# EasyEDA Pro project E33_Panel_2023.9.26.eprj, schematic Schematic1
Create Date: 2024-02-26; Page Name: Page1; Project Name: E33_Panel_2023.9.26; Schematic Name: Schematic1; Update Date: 2024-05-08; Company: 武汉理工大学WUTE车队; Drawed: 李家乐 姚宇; Page Size: A4; Reviewed: 肖世达; Version: V1.0
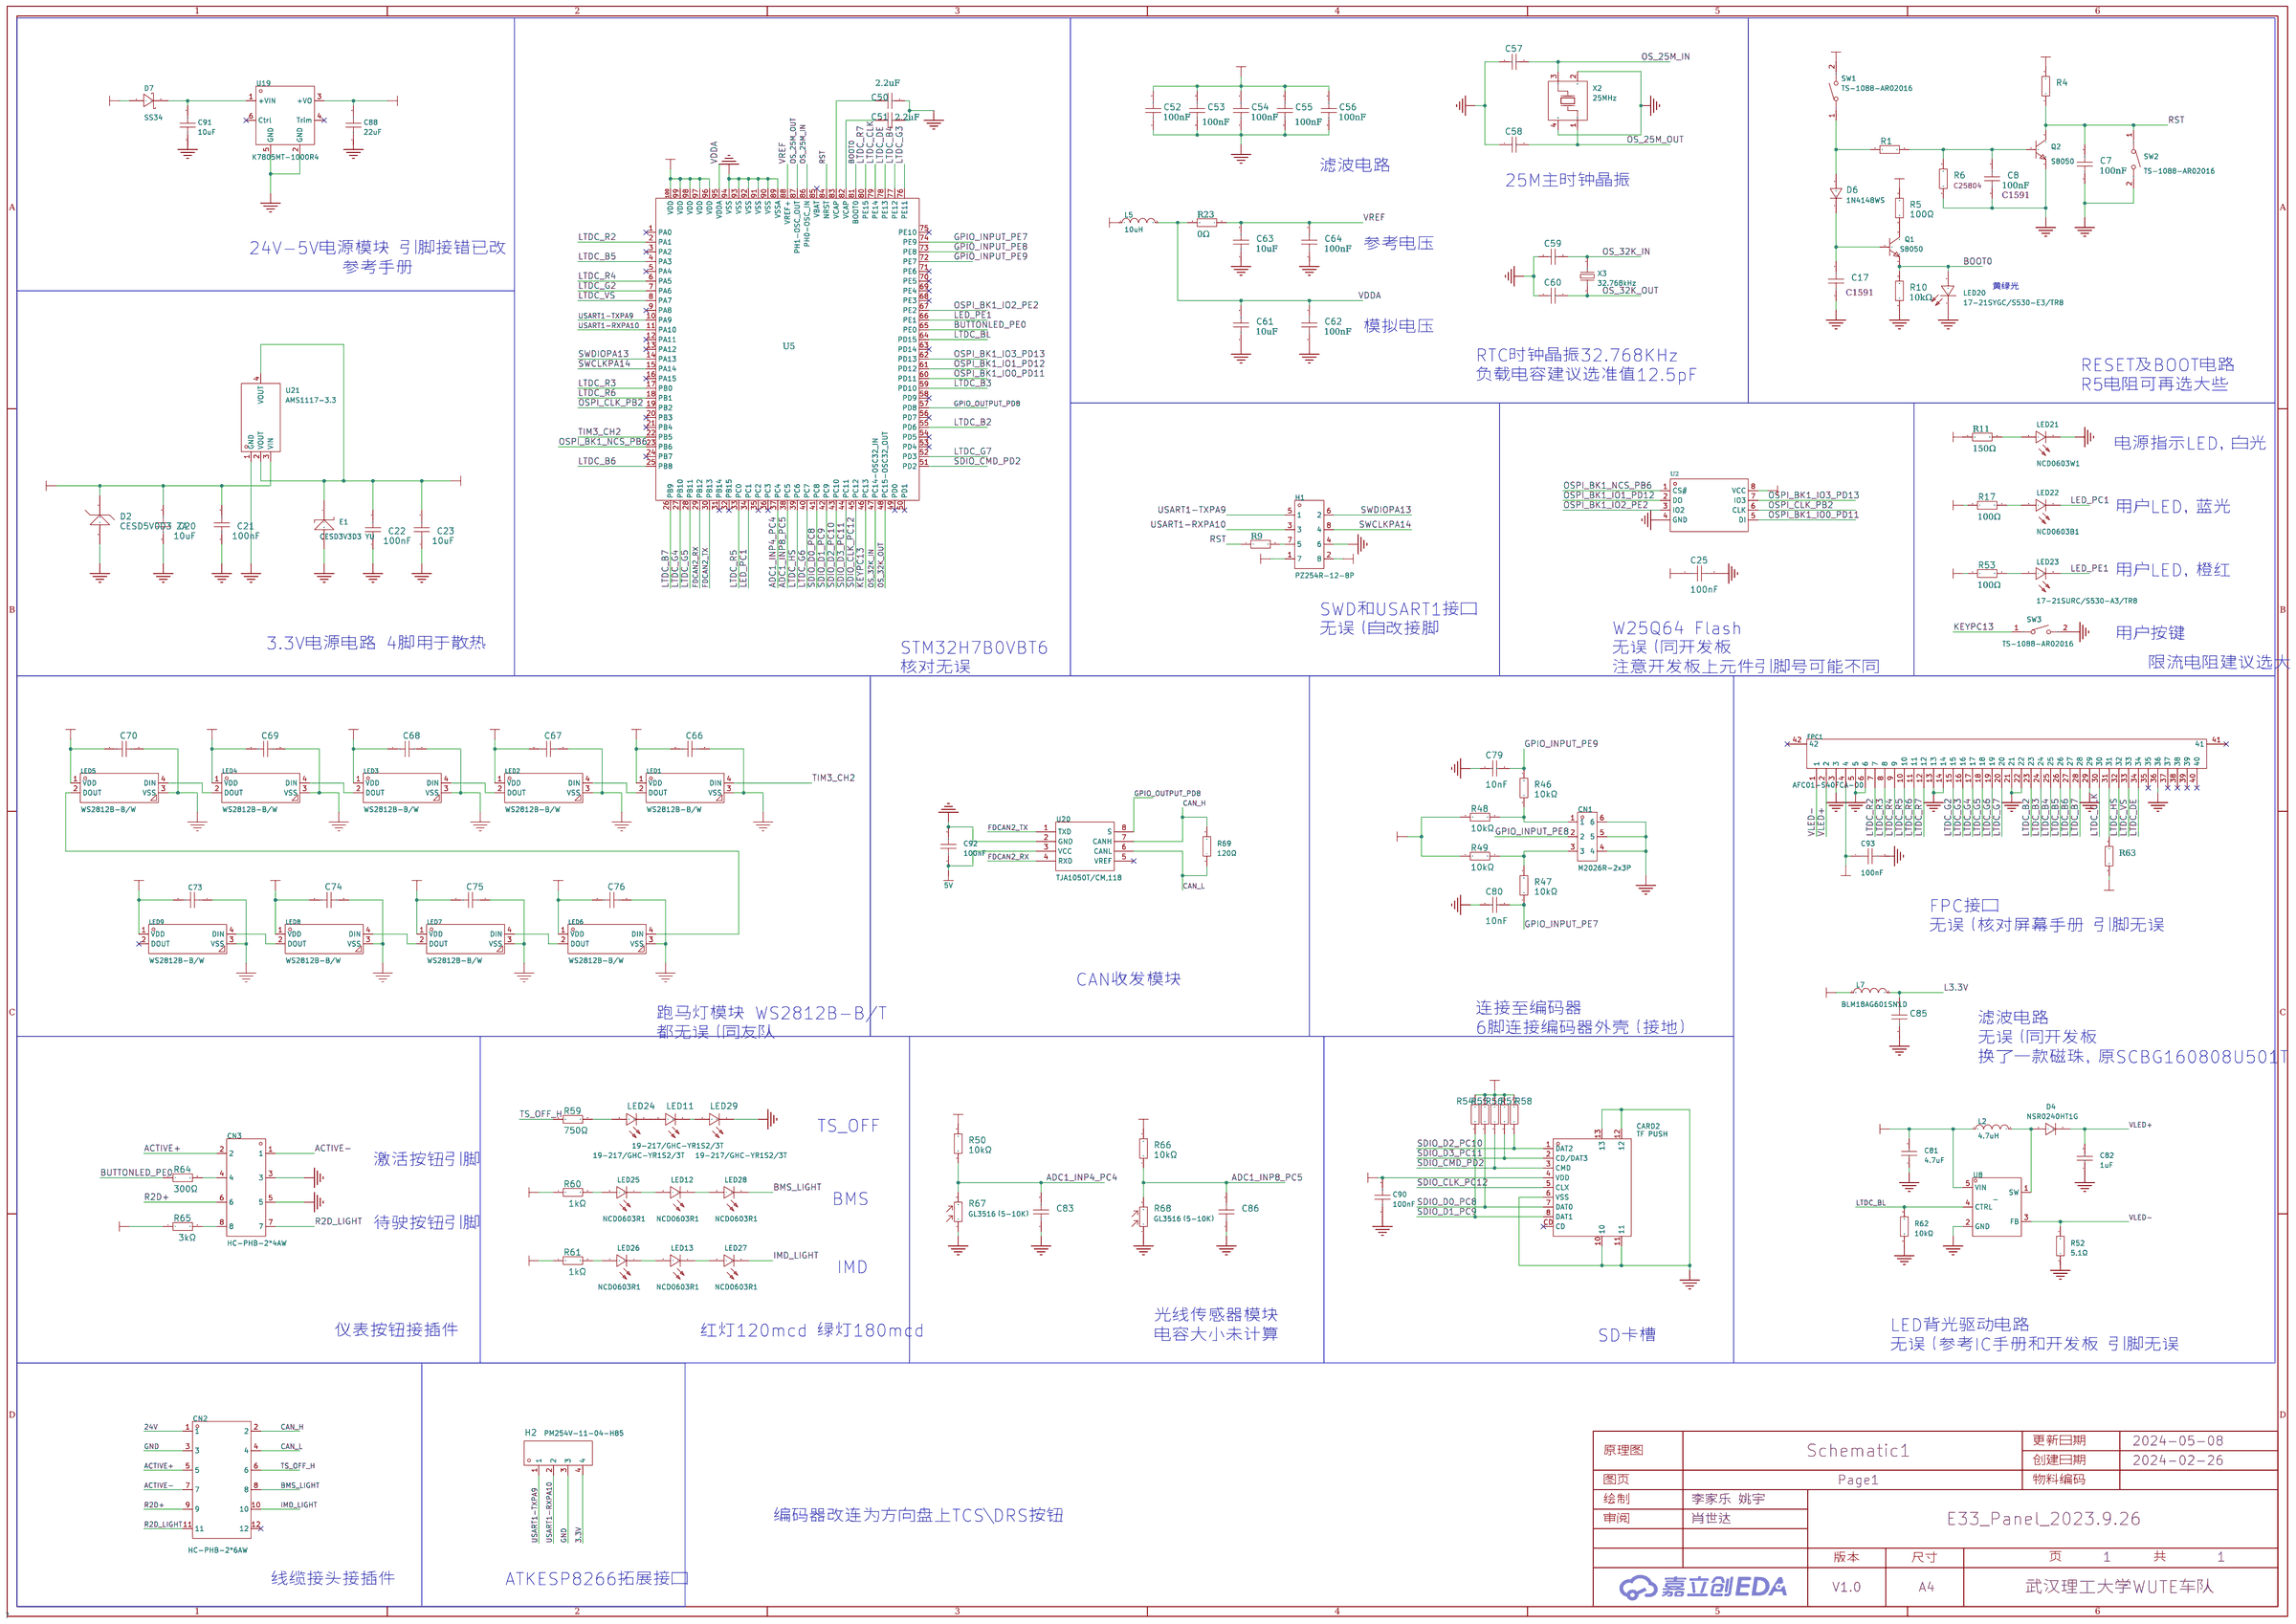
[diagram p0: schematic sheet]

## Parts
C7  100nF  [C0603]
C8  100nF  [C0603]
C17  100nF  [C0603]
C20  10uF  [C0603]
C21  100nF  [C0603]
C22  100nF  [C0603]
C23  10uF  [C0603]
C25  100nF  [C0603]
C50  2.2uF  [C0603]
C51  2.2uF  [C0603]
C52  100nF  [C0603]
C53  100nF  [C0603]
C54  100nF  [C0603]
C55  100nF  [C0603]
C56  100nF  [C0603]
C57  12pF  [C0603]
C58  12pF  [C0603]
C59  12pF  [C0603]
C60  12pF  [C0603]
C61  10uF  [C0603]
C62  100nF  [C0603]
C63  10uF  [C0603]
C64  100nF  [C0603]
C66  100nF  [C0603]
C67  100nF  [C0603]
C68  100nF  [C0603]
C69  100nF  [C0603]
C70  100nF  [C0603]
C73  100nF  [C0603]
C74  100nF  [C0603]
C75  100nF  [C0603]
C76  100nF  [C0603]
C79  10nF  [C0603]
C80  10nF  [C0603]
C81  4.7uF  [C0603]
C82  1uF  [C0603]
C83  100nF  [C0603]
C85  100nF  [C0603]
C86  100nF  [C0603]
C88  22uF  [C0603]
C90  100nF  [C0603]
C91  10uF  [C0603]
C92  100nF  [C0603]
C93  100nF  [C0603]
CARD2  TF PUSH  [TF-SMD_TF-PUSH]
CN1  M2026R-2x3P  [CONN-TH_M2026R-2X3P]
CN2  HC-PHB-2*6AW  [CONN-TH_12P-P2.00_HC-PHB-2X6AW]
CN3  HC-PHB-2*4AW  [CONN-TH_8P-P2.00_HCTL_HC-PHB-2X4AW]
D2  CESD5V0D3 ZA  [SOD-323_L1.8-W1.3-LS2.5-RD]
D4  NSR0240HT1G  [SOD-323_L1.8-W1.3-LS2.5-RD]
D6  1N4148WS  [SOD-323_L1.8-W1.3-LS2.5-RD]
D7  SS34  [SMA_L4.3-W2.6-LS5.2-RD]
E1  CESD3V3D3 YU  [SOD-323_L1.8-W1.3-LS2.5-RD]
FPC1  AFC01-S40FCA-00  [FPC-SMD_P0.50-40P_FGS-XJ-H2.0]
H1  PZ254R-12-8P  [HDR-TH_8P-P2.54-H-M-R2-C4-S2.54]
H2  PM254V-11-04-H85  [HDR-TH_4P-P2.54-V-F]
L2  4.7uH  [L0603]
L5  10uH  [L0603]
L7  BLM18AG601SN1D  [L0603]
LED1  WS2812B-B/W  [LED-SMD_4P-L5.0-W5.0-BL_TC5050RGB]
LED2  WS2812B-B/W  [LED-SMD_4P-L5.0-W5.0-BL_TC5050RGB]
LED3  WS2812B-B/W  [LED-SMD_4P-L5.0-W5.0-BL_TC5050RGB]
LED4  WS2812B-B/W  [LED-SMD_4P-L5.0-W5.0-BL_TC5050RGB]
LED5  WS2812B-B/W  [LED-SMD_4P-L5.0-W5.0-BL_TC5050RGB]
LED6  WS2812B-B/W  [LED-SMD_4P-L5.0-W5.0-BL_TC5050RGB]
LED7  WS2812B-B/W  [LED-SMD_4P-L5.0-W5.0-BL_TC5050RGB]
LED8  WS2812B-B/W  [LED-SMD_4P-L5.0-W5.0-BL_TC5050RGB]
LED9  WS2812B-B/W  [LED-SMD_4P-L5.0-W5.0-BL_TC5050RGB]
LED11  19-217/GHC-YR1S2/3T  [LED0603-RD]
LED12  NCD0603R1  [LED0603-RD_RED]
LED13  NCD0603R1  [LED0603-RD_RED]
LED20  17-21SYGC/S530-E3/TR8  [LED0805-RD]
LED21  NCD0603W1  [LED0603-RD]
LED22  NCD0603B1  [LED0603-RD]
LED23  17-21SURC/S530-A3/TR8  [LED0805-R-RD]
LED24  19-217/GHC-YR1S2/3T  [LED0603-RD]
LED25  NCD0603R1  [LED0603-RD_RED]
LED26  NCD0603R1  [LED0603-RD_RED]
LED27  NCD0603R1  [LED0603-RD_RED]
LED28  NCD0603R1  [LED0603-RD_RED]
LED29  19-217/GHC-YR1S2/3T  [LED0603-RD]
Q1  S8050  [SOT-23-3_L2.9-W1.6-P1.90-LS2.8-BR]
Q2  S8050  [SOT-23-3_L2.9-W1.6-P1.90-LS2.8-BR]
R1  10kΩ  [R0603]
R4  10kΩ  [R0603]
R5  100Ω  [R0603]
R6  10kΩ  [R0603]
R9  1kΩ  [R0603]
R10  10kΩ  [R0603]
R11  150Ω  [R0603]
R17  100Ω  [R0603]
R23  0Ω  [R0603]
R46  10kΩ  [R0603]
R47  10kΩ  [R0603]
R48  10kΩ  [R0603]
R49  10kΩ  [R0603]
R50  10kΩ  [R0603]
R52  5.1Ω  [R0603]
R53  100Ω  [R0603]
R54  10kΩ  [R0603]
R55  10kΩ  [R0603]
R56  10kΩ  [R0603]
R57  10kΩ  [R0603]
R58  10kΩ  [R0603]
R59  750Ω  [R0603]
R60  1kΩ  [R0603]
R61  1kΩ  [R0603]
R62  10kΩ  [R0603]
R63  10kΩ  [R0603]
R64  300Ω  [R0603]
R65  3kΩ  [R0603]
R66  10kΩ  [R0603]
R67  GL3516（5-10K）  [RES-TH_L5.1-W4.3-P3.40-D0.5]
R68  GL3516（5-10K）  [RES-TH_L5.1-W4.3-P3.40-D0.5]
R69  120Ω  [R0603]
SW1  TS-1088-AR02016  [SW-SMD_L3.9-W3.0-P4.45]
SW2  TS-1088-AR02016  [SW-SMD_L3.9-W3.0-P4.45]
SW3  TS-1088-AR02016  [SW-SMD_L3.9-W3.0-P4.45]
U2  W25Q64JVSSIQ  [SOP-8_L5.3-W5.3-P1.27-LS8.0-BL]
U5  STM32H7B0VBT6  [LQFP-100_L14.0-W14.0-P0.50-LS16.0-BL]
U8  -  [SC-70-5_L2.1-W1.3-P0.65-LS2.1-BR]
U19  K7805MT-1000R4  [PWRM-SMD_K78XXMT-1000R4]
U20  TJA1050T/CM,118  [SOIC-8_L5.0-W4.0-P1.27-LS6.0-BL]
U21  AMS1117-3.3  [SOT-223-3_L6.5-W3.4-P2.30-LS7.0-BR]
X2  25MHz  [OSC-SMD_4P-L3.2-W2.5-BL]
X3  32.768kHz  [FC-135R_L3.2-W1.5]

## Library data of the parts
C7 C8 C17 C21 C22 C25 C52-C56 C62 C64 C66-C70 C73-C76 C83 C85 C86 C90 C92 C93 = CL10B104KB8NNNC: 容值:100nF;精度:±10%;额定电压:50V;材质(温度系数):X7R;; LCSC Part Name: 100nF ±10% 50V; Supplier Part: C1591; Manufacturer: SAMSUNG(三星); Supplier Footprint: 0603; JLCPCB Part Class: Extended Part; Datasheet: https://atta.szlcsc.com/upload/public/pdf/source/20160103/1457707680512.pdf; Supplier: LCSC; Tolerance: ±10%; Voltage Rated: 50V; Temperature Coefficient: X7R
C20 C23 C61 C63 = CL10A106KP8NNNC: 容值:10uF;精度:±10%;额定电压:10V;材质(温度系数):X5R;; LCSC Part Name: 10uF ±10% 10V; Supplier Part: C19702; Manufacturer: SAMSUNG(三星); Supplier Footprint: 0603; JLCPCB Part Class: Basic Part; Datasheet: https://atta.szlcsc.com/upload/public/pdf/source/20160103/1457707703378.pdf; Supplier: LCSC; Tolerance: ±10%; Voltage Rated: 10V; Temperature Coefficient: X5R
C50 C51 = CL10A225KO8NNNC: 容值:2.2uF;精度:±10%;额定电压:16V;材质(温度系数):X5R;; LCSC Part Name: 2.2uF ±10% 16V; Supplier Part: C23630; Manufacturer: SAMSUNG(三星); Supplier Footprint: 0603; JLCPCB Part Class: Basic Part; Datasheet: https://atta.szlcsc.com/upload/public/pdf/source/20160103/1457707709512.pdf; Supplier: LCSC; Tolerance: ±10%; Voltage Rated: 16V; Temperature Coefficient: X5R
C57-C60 = CL10C120JB8NNNC: 容值:12pF;精度:±5%;额定电压:50V;材质(温度系数):C0G;; LCSC Part Name: 12pF ±5% 50V; Supplier Part: C38523; Manufacturer: SAMSUNG(三星); Supplier Footprint: 0603; JLCPCB Part Class: Basic Part; Datasheet: https://atta.szlcsc.com/upload/public/pdf/source/20160218/1457707763339.pdf; Supplier: LCSC; Tolerance: ±5%; Voltage Rated: 50V; Temperature Coefficient: C0G
C79 C80 = CL10B103KB8NNNC: 容值:10nF;精度:±10%;额定电压:50V;材质(温度系数):X7R;; LCSC Part Name: 10nF ±10% 50V; Supplier Part: C1589; Manufacturer: SAMSUNG(三星); Supplier Footprint: 0603; JLCPCB Part Class: Extended Part; Datasheet: https://atta.szlcsc.com/upload/public/pdf/source/20160103/1457707680084.pdf; Supplier: LCSC; Tolerance: ±10%; Voltage Rated: 50V; Temperature Coefficient: X7R
C81 = CL10A475KP8NNNC: 容值:4.7uF;精度:±10%;额定电压:10V;材质(温度系数):X5R;; LCSC Part Name: 4.7uF ±10% 10V; Supplier Part: C1705; Manufacturer: SAMSUNG(三星); Supplier Footprint: 0603; JLCPCB Part Class: Extended Part; Datasheet: https://atta.szlcsc.com/upload/public/pdf/source/20160103/1457707692180.pdf; Supplier: LCSC; Tolerance: ±10%; Voltage Rated: 10V; Temperature Coefficient: X5R
C82 = CL10A105KB8NNNC: 容值:1uF;精度:±10%;额定电压:50V;材质(温度系数):X5R;; LCSC Part Name: 1uF ±10% 50V; Supplier Part: C15849; Manufacturer: SAMSUNG(三星); Supplier Footprint: 0603; JLCPCB Part Class: Basic Part; Datasheet: https://atta.szlcsc.com/upload/public/pdf/source/20160103/1457707679084.pdf; Supplier: LCSC; Tolerance: ±10%; Voltage Rated: 50V; Temperature Coefficient: X5R
C88 = CL10A226MP8NUNE: 容值:22uF;精度:±20%;额定电压:10V;材质(温度系数):X5R;; LCSC Part Name: 22uF ±20% 10V; Supplier Part: C86295; Manufacturer: SAMSUNG(三星); Supplier Footprint: 0603; JLCPCB Part Class: Extended Part; Datasheet: https://atta.szlcsc.com/upload/public/pdf/source/20170325/1490427882169.pdf; Supplier: LCSC; Tolerance: ±20%; Voltage Rated: 10V; Temperature Coefficient: X5R
C91 = GRM188R6YA106MA73D: 容值:10uF;精度:±20%;额定电压:35V;材质(温度系数):-;; LCSC Part Name: 10uF ±20% 35V; Supplier Part: C194427; Manufacturer: muRata(村田); Supplier Footprint: 0603; JLCPCB Part Class: Extended Part; Datasheet: https://atta.szlcsc.com/upload/public/pdf/source/20210128/C194427_FCA3640823207DDB58700A82F1A19B5F.pdf; Supplier: LCSC; Tolerance: ±20%; Voltage Rated: 35V
CARD2 = TF PUSH: 卡类型:MicroSD卡(TF卡);连接器类型:卡座;卡连接方式:自弹式;本体最大高度:2mm;工作温度范围:-20℃~+90℃;; LCSC Part Name: 自弹式TF卡座 TF外焊式内存卡卡座; Supplier Part: C393941; Manufacturer: SHOU HAN(首韩); Supplier Footprint: SMD; Datasheet: https://atta.szlcsc.com/upload/public/pdf/source/20191011/C393941_0DDD896EE907FEB750D8B7B8982E2A67.pdf; Supplier: LCSC; Card Type: MicroSD卡(TF卡); Connector Type: 卡座; Card Connection Mode: 自弹式; Maximum Body Height: 2mm; Operating Temperature Range: -20℃~+90℃
CN1 = M2026R-2x3P: 参考系列:-;间距:2mm;插针结构:2x3P;排数:2;每排PIN数:3;行距:-;公母:公型插针;安装方式:弯插;额定电流:3A;工作温度范围:-25℃~+85℃;; LCSC Part Name: 2mm 2x3P 弯插; Supplier Part: C492591; Manufacturer: XFCN(兴飞); Supplier Footprint: 弯插,P=2mm; Datasheet: https://atta.szlcsc.com/upload/public/pdf/source/20200309/C492591_A3C88617EEB4152325271B39D2E99B68.pdf; Supplier: LCSC; Pitch: 2mm; Pins Structure: 2x3P; Number of Rows: 2; Number of PINs Per Row: 3; Gender: 公型插针; Mounting Style: 弯插; Current Rating (Max): 3A; Operating Temperature Range: -25℃~+85℃
CN2 = HC-PHB-2*6AW: 参考系列:-;间距:2mm;插针结构:2x6P;排数:2;每排PIN数:6;行距:2mm;公母:公型插针;安装方式:弯插;额定电流:3A;工作温度范围:-25℃~+85℃;; LCSC Part Name: 2mm 2x6P 弯插; Supplier Part: C2845599; Manufacturer: HCTL(华灿天禄); Supplier Footprint: 插件,P=2mm; Datasheet: https://atta.szlcsc.com/upload/public/pdf/source/20210728/C2845596_238E489321EB9BE37E286F652D496211.pdf; Supplier: LCSC; Pitch: 2mm; Pins Structure: 2x6P; Number of Rows: 2; Number of PINs Per Row: 6; Row Spacing: 2mm; Gender: 公型插针; Mounting Style: 弯插; Current Rating (Max): 3A; Operating Temperature Range: -25℃~+85℃
CN3 = HC-PHB-2*4AW: 参考系列:-;间距:2mm;插针结构:2x4P;排数:2;每排PIN数:4;行距:2mm;公母:公型插针;安装方式:弯插;额定电流:3A;工作温度范围:-25℃~+85℃;; LCSC Part Name: 2mm 2x4P 弯插; Supplier Part: C2845898; Manufacturer: HCTL(华灿天禄); Supplier Footprint: 弯插,P=2mm; Datasheet: https://atta.szlcsc.com/upload/public/pdf/source/20210806/C2845898_F0E6CDE538AA9F62365A2D9AC6C55FA2.pdf; Supplier: LCSC; Pitch: 2mm; Pins Structure: 2x4P; Number of Rows: 2; Number of PINs Per Row: 4; Row Spacing: 2mm; Gender: 公型插针; Mounting Style: 弯插; Current Rating (Max): 3A; Operating Temperature Range: -25℃~+85℃
D2 = CESD5V0D3 ZA: 极性:单向;反向截止电压(Vrwm):5V;击穿电压(VBR):6.2V;钳位电压(Vc)@Ipp:15.5V;; LCSC Part Name: 单向ESD; Supplier Part: C22643; Manufacturer: CJ(江苏长电/长晶); Supplier Footprint: SOD-323; JLCPCB Part Class: Extended Part; Datasheet: https://atta.szlcsc.com/upload/public/pdf/source/20140301/1457707004115.pdf; Supplier: LCSC; Polarity: 单向; Reverse Stand-Off Voltage (Vrwm): 5V; Breakdown Voltage (VBR): 6.2V; Peak Pulse Current(Ipp)@8/20us: 15A; Clamping Voltage@Ipp: 15.5V
D4 = NSR0240HT1G: 直流反向耐压(Vr):40V;平均整流电流(Io):250mA;正向压降(Vf):710mV@200mA;; LCSC Part Name: 40 V，0.25 A 低红外肖特基二极管; Supplier Part: C152519; Manufacturer: onsemi(安森美); Supplier Footprint: SOD-323; JLCPCB Part Class: Extended Part; Datasheet: https://atta.szlcsc.com/upload/public/pdf/source/20180125/C152519_15168647904761302641.PDF; Supplier: LCSC; Reverse Voltage (Vr): 40V; Average Rectified Current (Io): 250mA; Forward Voltage (Vf@If): 710mV@200mA
D6 = 1N4148WS_C2128: 二极管配置:独立式;功率:200mW;直流反向耐压(Vr):100V;平均整流电流(Io):150mA;正向压降(Vf):1.25V@150mA;反向电流(Ir):1uA@75V;反向恢复时间(trr):4ns;工作温度:+150℃@(Tj);; LCSC Part Name: 100V 150mA 4ns T4; Supplier Part: C2128; Manufacturer: CJ(江苏长电/长晶); Supplier Footprint: SOD-323; Supplier: LCSC; Diode Configuration: 独立式; Power Dissipation: 200mW; Reverse Voltage (Vr): 100V; Average Rectified Current (Io): 150mA; Forward Voltage (Vf@If): 1.25V@150mA; Reverse Leakage Current: 1uA@75V; Reverse Recovery Time (trr): 4ns; Operating Temperature: +150℃@(Tj)
D7 = SS34_C8678: 二极管配置:独立式;直流反向耐压(Vr):40V;平均整流电流(Io):3A;正向压降(Vf):550mV@3A;; LCSC Part Name: 40V 3A 550mV@3A; Supplier Part: C8678; Manufacturer: MDD; Supplier Footprint: SMA(DO-214AC); Datasheet: https://atta.szlcsc.com/upload/public/pdf/source/20230314/A80AE34493C69B89E2F4B1712F433538.pdf; Supplier: LCSC; Diode Configuration: 独立式; Reverse Voltage (Vr): 40V; Average Rectified Current (Io): 3A; Forward Voltage (Vf@If): 550mV@3A; Reverse Leakage Current (Ir): 500uA@40V
E1 = CESD3V3D3 YU: 极性:单向;反向截止电压(Vrwm):3.3V;击穿电压(VBR):5V;钳位电压(Vc)@Ipp:13V;; LCSC Part Name: 单向ESD; Supplier Part: C38388; Manufacturer: CJ(江苏长电/长晶); Supplier Footprint: SOD-323; Datasheet: https://atta.szlcsc.com/upload/public/pdf/source/20150915/1457707371129.pdf; Supplier: LCSC; Polarity: 单向; Reverse Stand-Off Voltage (Vrwm): 3.3V; Breakdown Voltage (VBR): 5V; Peak Pulse Current(Ipp)@8/20us: 16A; Clamping Voltage@Ipp: 13V
FPC1 = AFC01-S40FCA-00: 间距:0.5mm;触点数量:40;锁定特性:翻盖式;安装类型:卧贴;触点类型:下接;; LCSC Part Name: FPC 0.5MM 40P 翻盖式 H2.0mm 下接; Supplier Part: C262674; Manufacturer: JS(钜硕电子); Supplier Footprint: P=0.5mm; Supplier: LCSC; Pitch: 0.5mm; Number of Contacts: 40; Locking Feature: 翻盖式; Mounting Type: 卧贴; Contact Type: 下接; Height Above Board: 2mm; FFC, FCB Thickness: 0.3mm~0.3mm
H1 = PZ254R-12-8P: 排数:双排;总PIN位数:8P;间距:2.54mm;插针结构:2x4P;行距:2.54mm;安装类型:弯插;圆针/方针:方针;额定电流:-;额定电压:-;配合针长度:6mm;塑高:2.5mm;触头材质:黄铜;触头镀层:-;工作温度范围:-40℃~+105℃;颜色:黑色;; LCSC Part Name: 2.54mm 2x4P 弯插 方针; Supplier Part: C492432; Manufacturer: XFCN(兴飞); Supplier Footprint: 弯插,P=2.54mm; Datasheet: https://atta.szlcsc.com/upload/public/pdf/source/20200309/C492432_F55471C7391A7FE3415CB31C718B6320.pdf; Supplier: LCSC; Number of Rows: 双排; Number of Pins: 8P; Pitch: 2.54mm; Pin Structure: 2x4P; Row Spacing: 2.54mm; Mounting Type: 弯插; Circluar Pins/Square Pins: 方针; Length of Mating Pin: 6mm; Insulation Height: 2.5mm; Contact Material: 黄铜; Operating Temperature Range: -40℃~+105℃; Color: 黑色
H2 = PM254V-11-04-H85: 排数:单排;总孔位数:4;间距:2.54mm;插孔结构:1x4P;行距:-;安装类型:直插;塑高:-;触头材质:黄铜;触头镀层:-;; LCSC Part Name: 2.54mm 1x4P; Supplier Part: C541851; Manufacturer: XFCN(兴飞); Supplier Footprint: 直插,P=2.54mm; Supplier: LCSC; Number of Rows: 单排; Number of Holes: 4; Pitch: 2.54mm; Holes Structure: 1x4P; Mounting Type: 直插; Contact Material: 黄铜
L2 = SDFL1608Q4R7KTF: 电感值:4.7uH;精度:±10%;额定电流:15mA;饱和电流(Isat):-;直流电阻(DCR):2.1Ω;; LCSC Part Name: 4.7uH ±10%; Supplier Part: C1034; Manufacturer: Sunlord(顺络); Supplier Footprint: 0603; JLCPCB Part Class: Basic Part; Datasheet: https://atta.szlcsc.com/upload/public/pdf/source/20210816/855F4348312D259031B87CBCF31BE802.pdf; Supplier: LCSC; Tolerance: ±10%; Rated Current: 15mA; DC Resistance (DCR): 2.1Ω; Q @ Freq: 35@10MHz; Frequency - Self Resonant: 33MHz
L5 = MCL1608S100MT: 电感值:10uH;精度:±20%;额定电流:50mA;饱和电流(Isat):-;直流电阻(DCR):1.17Ω;; LCSC Part Name: 10uH ±20% 50mA 1.17Ω; Supplier Part: C51942; Manufacturer: Sunlord(顺络); Supplier Footprint: 0603; JLCPCB Part Class: Extended Part; Datasheet: https://atta.szlcsc.com/upload/public/pdf/source/20210916/ED8AF9AA4A96DD19D069D769FFCBDCB4.pdf; Supplier: LCSC; Tolerance: ±20%; Rated Current: 50mA; DC Resistance (DCR): 1.17Ω; Frequency - Self Resonant: 20MHz
L7 = BLM18AG601SN1D: 标称阻抗@测试频率:600Ω@100MHz;误差:±25%;直流电阻(RDC):380mΩ;; LCSC Part Name: 单路 0603磁珠 阻抗600Ω@100MHz; Supplier Part: C19330; Manufacturer: muRata(村田); Supplier Footprint: 0603; JLCPCB Part Class: Extended Part; Datasheet: https://atta.szlcsc.com/upload/public/pdf/source/20180326/C19330_93F4AC33FF94C8E22511353688ADC0FA.pdf; Supplier: LCSC; Impedance @ Frequency: 600Ω@100MHz; Tolerance: ±25%; DC Resistance: 380mΩ; Current Rating: 500mA; Circuits: 1
LED1-LED9 = WS2812B-B/W: 发光颜色:RGB三色;; LCSC Part Name: RGB三色 （注意防潮，请查阅规格书中对应具体内容）; Supplier Part: C114586; Manufacturer: worldsemi; Supplier Footprint: SMD5050; JLCPCB Part Class: 扩展库; Datasheet: https://atta.szlcsc.com/upload/public/pdf/source/20200615/C114586_26EB6813EC9F2A3F6C7FBB2AD75DE01F.pdf; Supplier: LCSC; Emitted Color: RGB三色
LED11 LED24 LED29 = 19-217/GHC-YR1S2/3T: 发光颜色:翠绿;二极管配置:-;主波长:520nm~535nm;色温:-;功率:110mW;安装方式:-;; LCSC Part Name: 翠绿; Supplier Part: C72043; Manufacturer: EVERLIGHT(亿光); Supplier Footprint: 0603; Datasheet: https://atta.szlcsc.com/upload/public/pdf/source/20160507/1462613613780.pdf; Supplier: LCSC; Emitted Color: 翠绿; Lens Color: 无色透明; Dominant Wavelength: 520nm~535nm; Peak Wavelength: 518nm; Forward Current: 20mA; Power Dissipation: 110mW; Viewing Angle: 120°; Operating Temperature: -40℃~+85℃
LED12 LED13 LED25-LED28 = NCD0603R1_C84263: 发光颜色:红灯;; LCSC Part Name: 红灯; Supplier Part: C84263; Manufacturer: 国星光电; Supplier Footprint: 0603; Datasheet: https://atta.szlcsc.com/upload/public/pdf/source/20200820/C84263_DABC6A75E58F576973B407FDBA283D60.pdf; Supplier: LCSC; Emitted Color: 红灯
LED20 = 17-21SYGC/S530-E3/TR8: 发光颜色:普绿/黄绿;; Supplier Part: C142303; Manufacturer: EVERLIGHT(亿光); Supplier Footprint: 0805; Datasheet: https://atta.szlcsc.com/upload/public/pdf/source/20171110/C142303_15102792667121104246.pdf; Supplier: LCSC; Emitted Color: 普绿/黄绿
LED21 = NCD0603W1: 发光颜色:白灯;; Supplier Part: C84265; Manufacturer: 国星光电; Supplier Footprint: 0603; Datasheet: https://atta.szlcsc.com/upload/public/pdf/source/20200820/C84265_479E6193713348A548E5CD6D9278BF16.pdf; Supplier: LCSC; Emitted Color: 白灯
LED22 = NCD0603B1: 发光颜色:蓝灯;; LCSC Part Name: 蓝灯; Supplier Part: C84266; Manufacturer: 国星光电; Supplier Footprint: 0603; Datasheet: https://atta.szlcsc.com/upload/public/pdf/source/20200820/C84266_6A3CDBEFA72C6CAD68EDA53474ADAE6C.pdf; Supplier: LCSC; Emitted Color: 蓝灯
LED23 = 17-21SURC/S530-A3/TR8: 发光颜色:橙红;二极管配置:-;主波长:624nm;色温:-;功率:60mW;安装方式:-;; LCSC Part Name: 橙红; Supplier Part: C72037; Manufacturer: EVERLIGHT(亿光); Supplier Footprint: 0805; Datasheet: https://atta.szlcsc.com/upload/public/pdf/source/20160507/1462613613540.pdf; Supplier: LCSC; Emitted Color: 橙红; Lens Color: 无色透明; Dominant Wavelength: 624nm; Peak Wavelength: 632nm; Forward Current: 20mA; Power Dissipation: 60mW; Viewing Angle: 140°; Operating Temperature: -40℃~+85℃
Q1 Q2 = S8050_C105433: 晶体管类型:NPN;集射极击穿电压(Vceo):25V;集电极电流(Ic):500mA;功率(Pd):300mW;直流电流增益(hFE@Ic,Vce):120@50mA,1V;; LCSC Part Name: NPN 25V 500mA L档 120-200; Supplier Part: C105433; Manufacturer: CJ(江苏长电/长晶); Supplier Footprint: SOT-23; Datasheet: https://atta.szlcsc.com/upload/public/pdf/source/20170415/1492237762328.pdf; Supplier: LCSC; Transistor Type: NPN; Collector-Emitter Breakdown Voltage (Vceo): 25V; Collector Current (Ic): 500mA; Power Dissipation (Pd): 300mW; Collector Cut-Off Current (Icbo): 100nA; Collector-Emitter Saturation Voltage (VCE(sat)@Ic,Ib): 600mV@500mA,50mA; DC Current Gain (hFE@Ic,Vce): 120@50mA,1V; Transition Frequency (fT): 150MHz; Operating Temperature: +150℃@(Tj)
R1 R4 R6 R10 R46-R50 R54-R58 R62 R63 R66 = 0603WAF1002T5E: 电阻类型:厚膜电阻;阻值:10kΩ;精度:±1%;功率:100mW;; LCSC Part Name: 厚膜电阻 10kΩ ±1% 100mW; Supplier Part: C25804; Manufacturer: UNI-ROYAL(厚声); Supplier Footprint: 0603; JLCPCB Part Class: Basic Part; Datasheet: https://atta.szlcsc.com/upload/public/pdf/source/20200306/C422600_1E6D84923E4A46A82E41ADD87F860B5C.pdf; Supplier: LCSC; Type: 厚膜电阻; Tolerance: ±1%; Power(Watts): 100mW; Temperature Coefficient: ±100ppm/℃; Overload Voltage (Max): 75V; Operating Temperature Range: -55℃~+155℃
R5 R17 R53 = 0603WAF1000T5E: 电阻类型:厚膜电阻;阻值:100Ω;精度:±1%;功率:100mW;; LCSC Part Name: 100Ω ±1% 100mW; Supplier Part: C22775; Manufacturer: UNI-ROYAL(厚声); Supplier Footprint: 0603; JLCPCB Part Class: Basic Part; Datasheet: https://atta.szlcsc.com/upload/public/pdf/source/20200306/C422600_1E6D84923E4A46A82E41ADD87F860B5C.pdf; Supplier: LCSC; Type: 厚膜电阻; Tolerance: ±1%; Power(Watts): 100mW; Temperature Coefficient: ±200ppm/℃; Overload Voltage (Max): 75V; Operating Temperature Range: -55℃~+155℃
R9 R60 R61 = 0603WAF1001T5E: 电阻类型:厚膜电阻;阻值:1kΩ;精度:±1%;功率:100mW;; LCSC Part Name: 1kΩ ±1% 100mW; Supplier Part: C21190; Manufacturer: UNI-ROYAL(厚声); Supplier Footprint: 0603; JLCPCB Part Class: Basic Part; Datasheet: https://atta.szlcsc.com/upload/public/pdf/source/20200306/C422600_1E6D84923E4A46A82E41ADD87F860B5C.pdf; Supplier: LCSC; Type: 厚膜电阻; Tolerance: ±1%; Power(Watts): 100mW; Temperature Coefficient: ±100ppm/℃; Overload Voltage (Max): 75V; Operating Temperature Range: -55℃~+155℃
R11 = 0603WAF1500T5E: 电阻类型:厚膜电阻;阻值:150Ω;精度:±1%;功率:100mW;; LCSC Part Name: 150Ω ±1% 100mW; Supplier Part: C22808; Manufacturer: UNI-ROYAL(厚声); Supplier Footprint: 0603; JLCPCB Part Class: Basic Part; Datasheet: https://atta.szlcsc.com/upload/public/pdf/source/20200306/C422600_1E6D84923E4A46A82E41ADD87F860B5C.pdf; Supplier: LCSC; Type: 厚膜电阻; Tolerance: ±1%; Power(Watts): 100mW; Temperature Coefficient: ±100ppm/℃; Overload Voltage (Max): 75V; Operating Temperature Range: -55℃~+155℃
R23 = 0603WAF0000T5E: 电阻类型:厚膜电阻;阻值:0Ω;精度:±1%;功率:100mW;; LCSC Part Name: 0Ω ±1% 100mW; Supplier Part: C21189; Manufacturer: UNI-ROYAL(厚声); Supplier Footprint: 0603; JLCPCB Part Class: Basic Part; Datasheet: https://atta.szlcsc.com/upload/public/pdf/source/20200306/C422600_1E6D84923E4A46A82E41ADD87F860B5C.pdf; Supplier: LCSC; Type: 厚膜电阻; Tolerance: ±1%; Power(Watts): 100mW; Overload Voltage (Max): 75V; Operating Temperature Range: -55℃~+155℃
R52 = 0603WAF510KT5E: 电阻类型:厚膜电阻;阻值:5.1Ω;精度:±1%;功率:100mW;; LCSC Part Name: 5.1Ω ±1% 100mW; Supplier Part: C25197; Manufacturer: UNI-ROYAL(厚声); Supplier Footprint: 0603; JLCPCB Part Class: Basic Part; Datasheet: https://atta.szlcsc.com/upload/public/pdf/source/20200306/C422600_1E6D84923E4A46A82E41ADD87F860B5C.pdf; Supplier: LCSC; Type: 厚膜电阻; Tolerance: ±1%; Power(Watts): 100mW; Temperature Coefficient: ±200ppm/℃; Overload Voltage (Max): 75V; Operating Temperature Range: -55℃~+155℃
R59 = RC0603FR-07750RL: 电阻类型:厚膜电阻;阻值:750Ω;精度:±1%;功率:100mW;; LCSC Part Name: 750Ω ±1% 100mW; Supplier Part: C114635; Manufacturer: YAGEO(国巨); Supplier Footprint: 0603; JLCPCB Part Class: Extended Part; Datasheet: https://atta.szlcsc.com/upload/public/pdf/source/20170912/C114635_1505207798260963450.pdf; Supplier: LCSC; Type: 厚膜电阻; Tolerance: ±1%; Power(Watts): 100mW; Temperature Coefficient: ±100ppm/℃; Overload Voltage (Max): 75V; Operating Temperature Range: -55℃~+155℃
R64 = 0603WAF3000T5E: 电阻类型:厚膜电阻;阻值:300Ω;精度:±1%;功率:100mW;; LCSC Part Name: 300Ω ±1% 100mW; Supplier Part: C23025; Manufacturer: UNI-ROYAL(厚声); Supplier Footprint: 0603; JLCPCB Part Class: Basic Part; Datasheet: https://atta.szlcsc.com/upload/public/pdf/source/20200306/C422600_1E6D84923E4A46A82E41ADD87F860B5C.pdf; Supplier: LCSC; Type: 厚膜电阻; Tolerance: ±1%; Power(Watts): 100mW; Temperature Coefficient: ±100ppm/℃; Overload Voltage (Max): 75V; Operating Temperature Range: -55℃~+155℃
R65 = 0603WAF3001T5E: 电阻类型:厚膜电阻;阻值:3kΩ;精度:±1%;功率:100mW;; LCSC Part Name: 3kΩ ±1% 100mW; Supplier Part: C4211; Manufacturer: UNI-ROYAL(厚声); Supplier Footprint: 0603; JLCPCB Part Class: Basic Part; Datasheet: https://atta.szlcsc.com/upload/public/pdf/source/20200306/C422600_1E6D84923E4A46A82E41ADD87F860B5C.pdf; Supplier: LCSC; Type: 厚膜电阻; Tolerance: ±1%; Power(Watts): 100mW; Temperature Coefficient: ±100ppm/℃; Overload Voltage (Max): 75V; Operating Temperature Range: -55℃~+155℃
R67 R68 = GL3516（5-10K）: 光谱峰值(波长):540nm;最大电压:150V;亮电阻 @ 10Lux:5kΩ~10kΩ;暗电阻:500kΩ;; LCSC Part Name: GL3516（5-10K）不环保; Supplier Part: C11287; Manufacturer: JCHL(晶创和立); Supplier Footprint: 插件,P=2mm; JLCPCB Part Class: 扩展库; Supplier: LCSC; Spectral Peak: 540nm; Applied Voltage: 150V; Illuminated Resistance @ 10Lux: 5kΩ~10kΩ; Dark Resistance: 500kΩ
R69 = 0603WAF1200T5E: 电阻类型:厚膜电阻;阻值:120Ω;精度:±1%;功率:100mW;; LCSC Part Name: 120Ω ±1% 100mW; Supplier Part: C22787; Manufacturer: UNI-ROYAL(厚声); Supplier Footprint: 0603; JLCPCB Part Class: Basic Part; Datasheet: https://atta.szlcsc.com/upload/public/pdf/source/20200306/C422600_1E6D84923E4A46A82E41ADD87F860B5C.pdf; Supplier: LCSC; Type: 厚膜电阻; Tolerance: ±1%; Power(Watts): 100mW; Temperature Coefficient: ±100ppm/℃; Overload Voltage (Max): 75V; Operating Temperature Range: -55℃~+155℃
SW1-SW3 = TS-1088-AR02016: 触点电流:50mA;额定电压(DC):12V;绝缘电阻:100MΩ;电路结构:单刀单掷;安装方式:立贴;作用力:160gf@±50gf;机械寿命:10万次;带支架:否;; LCSC Part Name: 4*3*2mm 立贴 轻触开关; Supplier Part: C720477; Manufacturer: XUNPU(讯普); Supplier Footprint: SMD; Datasheet: https://atta.szlcsc.com/upload/public/pdf/source/20200810/C720475_60D09DD6C54279ADDB2DC25100F1CC11.pdf; Supplier: LCSC; Contact Current: 50mA; Voltage Rating (DC): 12V; Insulation Resistance: 100MΩ; Circuit: 单刀单掷; Mounting Style: 立贴; Actuator Style: 圆形按钮; Actuator/Cap Color: 黑色; Operating Force: 160gf@±50gf; Mechanical Life: 10万次; Operating Temperature: -30℃~+80℃; Pin Style: SMD接片; Switch Length: 4mm; Switch Width: 3mm; Switch Height: 2mm; Strike Gundam: 否
U2 = W25Q64JVSSIQ_C83140: 64M-bit/8M-byte FLASH芯片,SPI接口 133MHz(266/532MHz Dual/Quad-SPI) 比W25Q64FVSSIG更高速度; Supplier Part: C83140; Manufacturer: WINBOND(华邦); Supplier Footprint: SOP-8-208mil; JLCPCB Part Class: Extended Part; Datasheet: https://atta.szlcsc.com/upload/public/pdf/source/20161110/1478742546019.pdf; Supplier: LCSC
U5 = STM32H7B0VBT6: CPU内核:ARM-M系列;CPU最大主频:280MHz;程序存储容量:128KB;程序存储器类型:FLASH;RAM总容量:1.4MB;GPIO端口数量:80;; LCSC Part Name: ARM-M系列 280MHz; Supplier Part: C730227; Manufacturer: ST(意法半导体); Supplier Footprint: LQFP-100(14x14); JLCPCB Part Class: Extended Part; Datasheet: https://atta.szlcsc.com/upload/public/pdf/source/20200902/C730225_664883C886B4E760FDC927233147DBDC.pdf; Supplier: LCSC; CPU Core: ARM-M系列; CPU Maximum Speed: 280MHz; Operating Voltage Range: 1.62V~3.6V; Program Storage Size: 128KB; Program Memory Type: FLASH; RAM Size: 1.4MB; GPIO Ports Number: 80; ADC (Bit): 16bit; DAC (Bit): 12bit; Universal Serial Bus: 有; Peripheral/Function: DMA；LCD/LED驱动; Watchdog: 有; Infrared Data Association: 有; Low-Voltage Detect: 有; LCD Module: 有; Secure Digital Input and Output: 有; Direct Memory Access: 有; Internal Oscillator: 有; Operating Temperature Range: -40℃~+85℃
U8 = TPS61169DCKR: 类型:-;拓扑结构:-;内部开关:-;供电电压（最低）:-;供电电压（最高）:-;频率:-;; Supplier Part: C71045; Manufacturer: TI(德州仪器); Supplier Footprint: SC-70-5; JLCPCB Part Class: Extended Part; Datasheet: https://atta.szlcsc.com/upload/public/pdf/source/20170728/C71045_1501225885482849061.pdf; Supplier: LCSC
U19 = K7805MT-1000R4: Supplier Part: C2692189; Manufacturer: MORNSUN(金升阳); JLCPCB Part Class: Extended Part; Datasheet: https://atta.szlcsc.com/upload/public/pdf/source/20210226/C2692193_0F98C46D11199DA683736495D9F276D2.pdf; Supplier: LCSC
U20 = TJA1050T/CM,118: 类型:收发器;; LCSC Part Name: 4.75V~5.25V; Supplier Part: C6952; Manufacturer: NXP(恩智浦); Supplier Footprint: SOIC-8; Datasheet: https://atta.szlcsc.com/upload/public/pdf/source/20140411/1457707042917.pdf; Supplier: LCSC; Type: 收发器; Supply Voltage: 4.75V~5.25V; Supply Current: 50mA
U21 = AMS1117-3.3_C6186: 输出类型:固定;最大输入电压:-;输出电压:3.3V;最大输出电流:1A;电源纹波抑制比(PSRR):72dB@(120Hz);输出极性:正极;; LCSC Part Name: 输出3.3V 1A; Supplier Part: C6186; Manufacturer: AMS; Supplier Footprint: SOT-223-3; Datasheet: https://atta.szlcsc.com/upload/public/pdf/source/20180727/C6186_7A095716F0823C02F1997A905E26C086.pdf; Supplier: LCSC; Output Type: 固定; Output Voltage: 3.3V; MAX Output Current: 1A; Power Supply Rejection Ratio (PSRR): 72dB@(120Hz); Dropout Voltage: 1.3V@(800mA); Output Polarity: 正极; Number of Outputs: 1
X2 = X322525MOB4SI: 频率:25MHz;频率公差:±10ppm;负载电容:12pF;; LCSC Part Name: 25MHz ±10ppm 12pF YSX321SL; Supplier Part: C9006; Manufacturer: YXC(扬兴晶振); Supplier Footprint: SMD3225-4P; Datasheet: https://atta.szlcsc.com/upload/public/pdf/source/20210329/C112971_1F611BDC486E193C1706F6D8EB5AA189.pdf; Supplier: LCSC; Crystal Type: 贴片无源晶振; Frequency Tolerance: ±10ppm; Frequency Stability: ±30ppm; Load Capacitance: 12pF; Operating Temperature: -40℃~+85℃
X3 = Q13FC1350000400: 频率:32.768kHz;频率公差:±20ppm;负载电容:12.5pF;; LCSC Part Name: 32.768kHz ±20ppm 12.5pF; Supplier Part: C32346; Manufacturer: EPSON(爱普生); Supplier Footprint: SMD3215-2P; Datasheet: https://atta.szlcsc.com/upload/public/pdf/source/20190108/C32346_746D6B07EAF90824457A96480007685F.pdf; Supplier: LCSC; Crystal Type: 贴片无源晶振; Frequency Tolerance: ±20ppm; Load Capacitance: 12.5pF; Equivalent Series Resistance (ESR): 70kΩ; Operating Temperature: -40℃~+85℃

## Nets
3.3V: C22.2 C23.2 C25.1 C52.2 C53.2 C54.2 C55.2 C56.2 C90.2 CARD2.4(VDD) E1.1 H1.1(7) H2.4 L5.1 L7.1 R4.2 R5.2 R11.1 R17.1 R48.1 R49.1 R50.2 R53.1 R54.2 R55.2 R56.2 R57.2 R58.2 R66.2 SW1.2 U2.8(VCC) U5.96(VDD) U5.97(VDD) U5.98(VDD) U5.99(VDD) U5.100(VDD) U21.2(VOUT) U21.4(VOUT)
5V: C20.2 C21.2 C66.1 C67.1 C68.1 C69.1 C70.1 C73.2 C74.2 C75.2 C76.2 C81.2 C88.2 C92.1 D2.1 H1.2(8) L2.1 LED1.1(VDD) LED2.1(VDD) LED3.1(VDD) LED4.1(VDD) LED5.1(VDD) LED6.1(VDD) LED7.1(VDD) LED8.1(VDD) LED9.1(VDD) U8.5(VIN) U19.3(+VO) U20.3(VCC) U21.3(VIN)
24V: CN2.1 D7.2(A) R60.1 R61.1 R65.1
GND: C7.1 C8.1 C17.1 C20.1 C21.1 C22.1 C23.1 C25.2 C50.1 C51.1 C52.1 C53.1 C54.1 C55.1 C56.1 C57.1 C58.1 C59.1 C60.1 C61.1 C62.1 C63.1 C64.1 C66.2 C67.2 C68.2 C69.2 C70.2 C73.1 C74.1 C75.1 C76.1 C79.1 C80.1 C81.1 C82.1 C83.1 C85.1 C86.1 C88.1 C90.1 C91.1 C92.2 C93.2 CARD2.6(VSS) CARD2.10 CARD2.11 CARD2.12 CARD2.13 CN1.4 CN1.5 CN1.6 CN2.3 CN3.3 CN3.5 D2.2 E1.2 FPC1.3 FPC1.5 FPC1.6 FPC1.13 FPC1.14 FPC1.21 FPC1.22 FPC1.29 FPC1.36 H1.4(6) H2.3 LED1.3(VSS) LED2.3(VSS) LED3.3(VSS) LED4.3(VSS) LED5.3(VSS) LED6.3(VSS) LED7.3(VSS) LED8.3(VSS) LED9.3(VSS) LED20.1(K) LED21.1(-) LED29.1(C) Q2.2 R6.1 R10.1 R52.1 R62.1 R67.1 R68.1 SW2.2 SW3.2 U2.4(GND) U5.89(VSSA) U5.90(VSS) U5.91(VSS) U5.92(VSS) U5.93(VSS) U5.94(VSS) U8.2(GND) U19.2(GND) U19.5(GND) U20.2(GND) U21.1(GND) X2.2(GND) X2.4(GND)
VDDA: C61.2 C62.2 L5.2 R23.2 U5.95(VDDA)
ACTIVE+: CN2.5 CN3.2
ACTIVE-: CN2.7 CN3.1
ADC1_INP4_PC4: C83.2 R50.1 R67.2 U5.37(PC4)
ADC1_INP8_PC5: C86.2 R66.1 R68.2 U5.38(PC5)
BMS_LIGHT: CN2.8 LED28.1(K)
BOOT0: LED20.2(A) Q1.2 R10.2 U5.81(BOOT0)
BUTTONLED_PE0: R64.1 U5.65(PE0)
CAN_H: CN2.2 R69.2 U20.7(CANH)
CAN_L: CN2.4 R69.1 U20.6(CANL)
FDCAN2_RX: U5.29(PB12) U20.4(RXD)
FDCAN2_TX: U5.30(PB13) U20.1(TXD)
GPIO_INPUT_PE7: C80.2 R47.1 U5.74(PE9)
GPIO_INPUT_PE8: CN1.2 U5.73(PE8)
GPIO_INPUT_PE9: C79.2 R46.2 U5.72(PE7)
GPIO_OUTPUT_PD8: U5.57(PD8) U20.8(S)
IMD_LIGHT: CN2.10 LED27.1(K)
KEYPC13: SW3.1 U5.46(PC13)
L3.3V: C85.2 C93.1 FPC1.4 L7.2 R63.1
LED_PC1: LED22.1(-) U5.34(PC1)
LED_PE1: LED23.2(C) U5.66(PE1)
LTDC_B2: FPC1.23 U5.55(PD6)
LTDC_B3: FPC1.24 U5.59(PD10)
LTDC_B4: FPC1.25 U5.77(PE12)
LTDC_B5: FPC1.26 U5.4(PA3)
LTDC_B6: FPC1.27 U5.25(PB8)
LTDC_B7: FPC1.28 U5.26(PB9)
LTDC_BL: R62.2 U5.64(PD15) U8.4(CTRL)
LTDC_CLK: FPC1.30 U5.79(PE14)
LTDC_DE: FPC1.34 U5.78(PE13)
LTDC_G2: FPC1.15 U5.7(PA6)
LTDC_G3: FPC1.16 U5.76(PE11)
LTDC_G4: FPC1.17 U5.27(PB10)
LTDC_G5: FPC1.18 U5.28(PB11)
LTDC_G6: FPC1.19 U5.40(PC7)
LTDC_G7: FPC1.20 U5.52(PD3)
LTDC_HS: FPC1.32 U5.39(PC6)
LTDC_R2: FPC1.7 U5.2(PA1)
LTDC_R3: FPC1.8 U5.17(PB0)
LTDC_R4: FPC1.9 U5.6(PA5)
LTDC_R5: FPC1.10 U5.33(PC0)
LTDC_R6: FPC1.11 U5.18(PB1)
LTDC_R7: FPC1.12 U5.80(PE15)
LTDC_VS: FPC1.33 U5.8(PA7)
OS_25M_IN: C57.2 U5.86(PH0-OSC_IN) X2.3(OSC2)
OS_25M_OUT: C58.2 U5.87(PH1-OSC_OUT) X2.1(OSC1)
OS_32K_IN: C59.2 U5.47(PC14-OSC32_IN) X3.2
OS_32K_OUT: C60.2 U5.48(PC15-OSC32_OUT) X3.1
OSPI_BK1_IO0_PD11: U2.5(DI) U5.60(PD11)
OSPI_BK1_IO1_PD12: U2.2(DO) U5.61(PD12)
OSPI_BK1_IO2_PE2: U2.3(IO2) U5.67(PE2)
OSPI_BK1_IO3_PD13: U2.7(IO3) U5.62(PD13)
OSPI_BK1_NCS_PB6: U2.1(CS#) U5.23(PB6)
OSPI_CLK_PB2: U2.6(CLK) U5.19(PB2)
R2D+: CN2.9 CN3.6
R2D_LIGHT: CN2.11 CN3.7
RST: C7.2 Q2.3 R4.1 R9.1 SW2.1 U5.84(NRST)
SDIO_CLK_PC12: CARD2.5(CLX) U5.45(PC12)
SDIO_CMD_PD2: CARD2.3(CMD) R56.1 U5.51(PD2)
SDIO_D0_PC8: CARD2.7(DAT0) R55.1 U5.41(PC8)
SDIO_D1_PC9: CARD2.8(DAT1) R54.1 U5.42(PC9)
SDIO_D2_PC10: CARD2.1(DAT2) R58.1 U5.43(PC10)
SDIO_D3_PC11: CARD2.2(CD/DAT3) R57.1 U5.44(PC11)
SWCLKPA14: H1.8(4) U5.15(PA14)
SWDIOPA13: H1.6(2) U5.14(PA13)
TIM3_CH2: LED1.4(DIN) U5.22(PB5)
TS_OFF_H: CN2.6 R59.1
USART1-RXPA10: H1.3 H2.2 U5.11(PA10)
USART1-TXPA9: H1.5(1) H2.1 U5.10(PA9)
VLED+: C82.2 D4.1(C) FPC1.2
VLED-: FPC1.1 R52.2 U8.3(FB)
VREF: C63.2 C64.2 R23.1 U5.88(VREF+)
$1N3072: D6.2(A) R1.1 SW1.1
$1N3073: C8.2 Q2.1 R1.2 R6.2
$1N3080: C17.2 D6.1(K) Q1.1
$1N3093: LED21.2(+) R11.2
$1N3094: LED22.2(+) R17.2
$1N3236: FPC1.31 R63.2
$1N3252: LED4.2(DOUT) LED5.4(DIN)
$1N3253: LED3.2(DOUT) LED4.4(DIN)
$1N3254: LED2.2(DOUT) LED3.4(DIN)
$1N3255: LED1.2(DOUT) LED2.4(DIN)
$1N3256: LED6.2(DOUT) LED7.4(DIN)
$1N3257: LED7.2(DOUT) LED8.4(DIN)
$1N3330: LED23.1(A) R53.2
$1N3457: LED8.2(DOUT) LED9.4(DIN)
$1N3464: LED5.2(DOUT) LED6.4(DIN)
$1N160553: H1.7(5) R9.2
$1N161135: D4.2(A) L2.2 U8.1(SW)
$1N163903: CN1.1 R46.1 R48.2
$1N163918: CN1.3 R47.2 R49.2
$1N186967: Q1.3 R5.1
$1N212327: C91.2 D7.1(K) U19.1(+VIN)
$1N223537: LED24.2(A) R59.2
$1N223538: LED11.2(A) LED24.1(C)
$1N223574: LED25.2(A) R60.2
$1N223575: LED12.2(A) LED25.1(K)
$1N223611: LED26.2(A) R61.2
$1N223612: LED13.2(A) LED26.1(K)
$1N238063: LED13.1(K) LED27.2(A)
$1N238102: LED12.1(K) LED28.2(A)
$1N238151: LED11.1(C) LED29.2(A)
Net-(C50-2): C50.2 U5.83(VCAP)
Net-(C51-2): C51.2 U5.82(VCAP)
Net-(CN3-4): CN3.4 R64.2
Net-(CN3-8): CN3.8 R65.2

Not connected (* = marked no-connect by the designer): CARD2 CD*; CN2 12*; FPC1 35* 37* 38* 39* 40* 41* 42*; LED9 2(DOUT)*; U5 1(PA0)* 3(PA2)* 5(PA4)* 9(PA8)* 12(PA11)* 13(PA12)* 16(PA15)* 20(PB3)* 21(PB4)* 24(PB7)* 31(PB14)* 32(PB15)* 35(PC2)* 36(PC3)* 49(PD0)* 50(PD1)* 53(PD4)* 54(PD5)* 56(PD7)* 58(PD9)* 63(PD14)* 68(PE3)* 69(PE4)* 70(PE5)* 71(PE6)* 75(PE10)* 85(VBAT)*; U19 4(Trim)* 6(Ctrl)*; U20 5(VREF)*

## Notes on the sheet
- 滤波电路
- 25M主时钟晶振
- 24V-5V电源模块 引脚接错已改
  参考手册
- 参考电压
- 黄绿光
- 模拟电压
- RTC时钟晶振32.768KHz
  负载电容建议选准值12.5pF
- RESET及BOOT电路
  R5电阻可再选大些
- 电源指示LED，白光
- 用户LED，蓝光
- 用户LED，橙红
- W25Q64 Flash
  无误（同开发板
  注意开发板上元件引脚号可能不同
- STM32H7B0VBT6
  核对无误
- SWD和USART1接口
  无误（自改接脚
- 用户按键
- 3.3V电源电路 4脚用于散热
- 限流电阻建议选大
- FPC接口
  无误（核对屏幕手册 引脚无误
- CAN收发模块
- 跑马灯模块 WS2812B-B/T
  都无误（同友队
- 连接至编码器
  6脚连接编码器外壳（接地）
- 滤波电路
  无误（同开发板
  换了一款磁珠，原SCBG160808U501T
- TS_OFF
- 激活按钮引脚
- BMS
- 待驶按钮引脚
- IMD
- 光线传感器模块
  电容大小未计算
- LED背光驱动电路
  无误（参考IC手册和开发板 引脚无误
- 仪表按钮接插件
- 红灯120mcd 绿灯180mcd
- SD卡槽
- 编码器改连为方向盘上TCS\DRS按钮
- 线缆接头接插件
- ATKESP8266拓展接口
